# EasyEDA Pro project MushIO_V1p0_Final.eprj, schematic MushIO_V1p0_Final (continued)
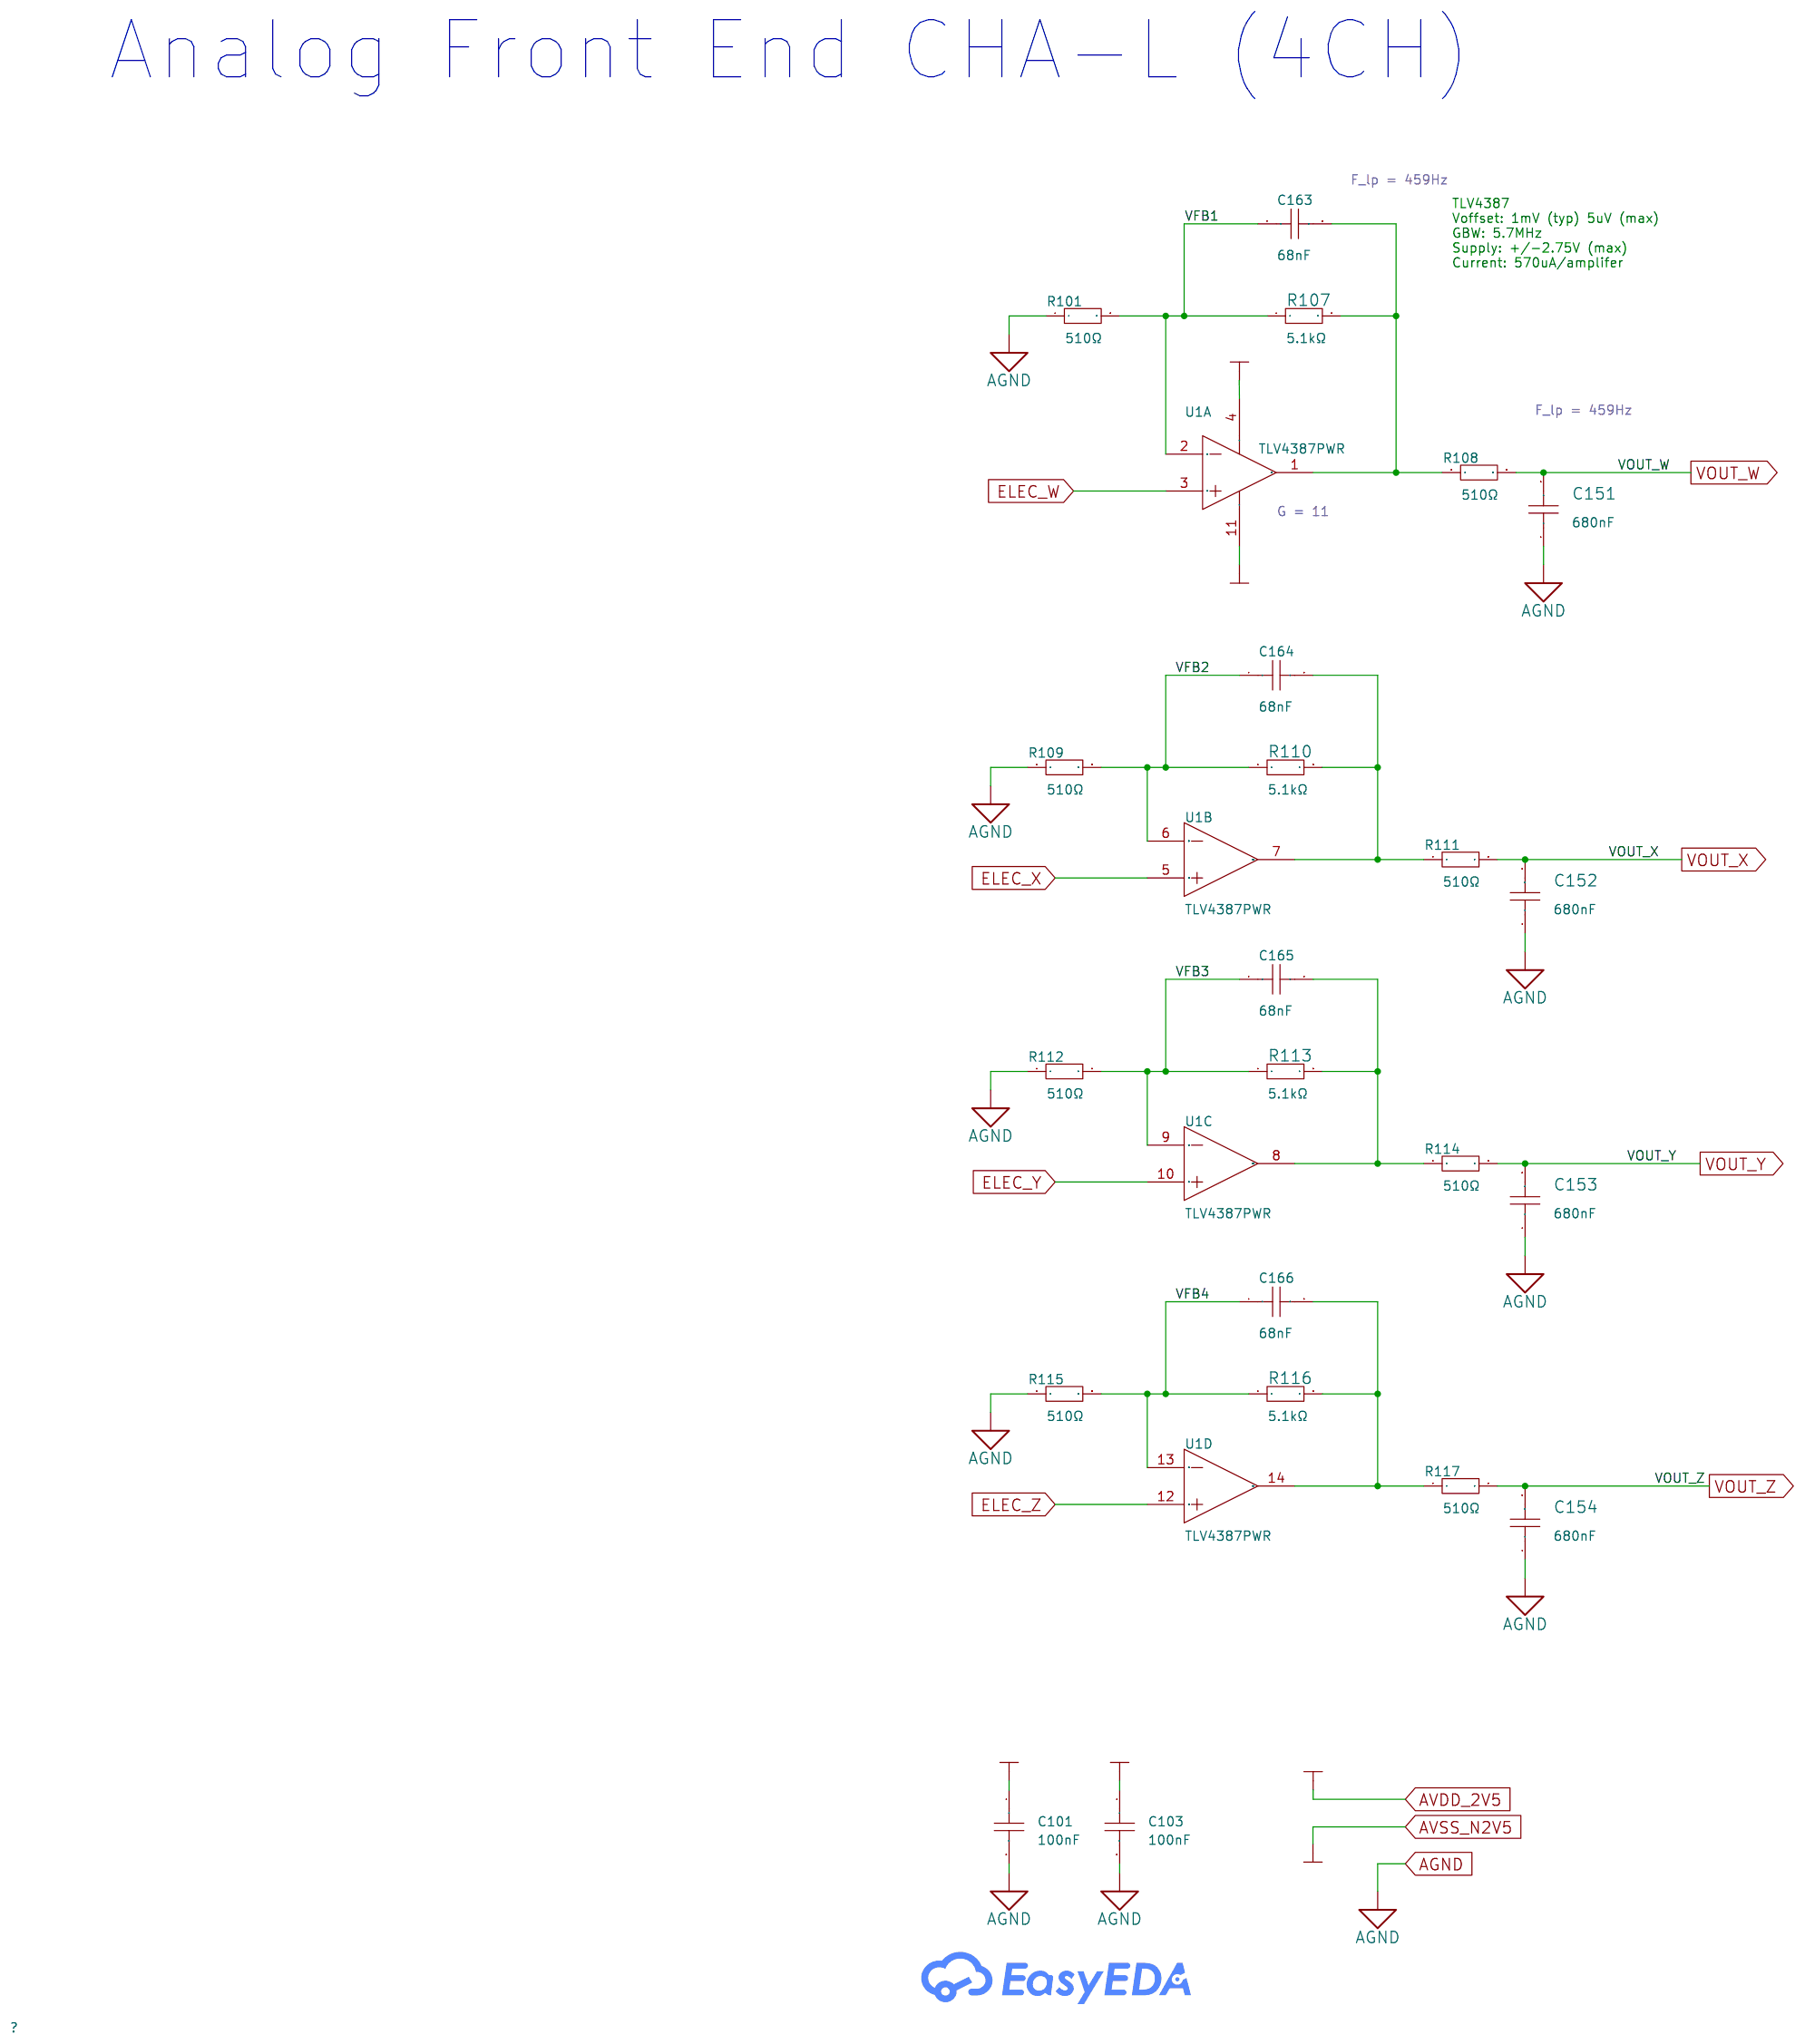
[diagram p0: schematic sheet]
## Library data of the parts
C501 C503-C509 C512 C602 C604 C621 C625 C634-C639 C643 = CL05B104KO5NNNC: Capacitance: Tolerance:±10% Tolerance:±10% Voltage Rated: Temperature Coefficient:; LCSC Part Name: 100nF ±10% 16V; Supplier Part: C1525; Manufacturer: SAMSUNG(三星); Supplier Footprint: 0402; JLCPCB Part Class: Basic Part; Datasheet: https://atta.szlcsc.com/upload/public/pdf/source/20160218/1457707763339.pdf; Supplier: LCSC; Tolerance: ±10%; Check: true
R201-R204 R301-R304 R401-R404 R503-R507 R509-R512 R514-R518 R522-R526 R528 R529 R635 R640 R641 = 0402WGF220JTCE: Type:Thick Film Resistors Resistance:22Ω Tolerance:±1% Tolerance:±1% Power(Watts): Overload Voltage (Max): Temperature Coefficient:±100ppm/℃ Temperature Coefficient:±100ppm/℃ Operating Temperature Range:-55℃~+155℃ Operating Temperature Range:-55℃~+155℃; LCSC Part Name: 22Ω ±1% 62.5mW 厚膜电阻; Supplier Part: C25092; Manufacturer: UNI-ROYAL(厚声); Supplier Footprint: 0402; JLCPCB Part Class: Basic Part; Datasheet: https://atta.szlcsc.com/upload/public/pdf/source/20200306/C422600_1E6D84923E4A46A82E41ADD87F860B5C.pdf; Supplier: LCSC; Type: Thick Film Resistors; Tolerance: ±1%; Temperature Coefficient: ±100ppm/℃; Operating Temperature Range: -55℃~+155℃; Check: true
TP201-TP206 TP301-TP311 TP313-TP320 TP401-TP406 TP501 TP601-TP604 TP607-TP624 TP626-TP631 TP633 TP634 TP636 TP637 TP640-TP642 = RCUCTE: Connector Type:Iron ring type (patch) Plastic Color:No plastic Board Space (Diameter φ/ Length x Width):1.6mmx0.8mm; Supplier Part: C159867; Manufacturer: KOA; JLCPCB Part Class: Extended Part; Datasheet: https://atta.szlcsc.com/upload/public/pdf/source/20171228/C159868_15144411255991213551.pdf; Supplier: LCSC; Connector Type: Iron ring type (patch); Plastic Color: No plastic; Board Space (Diameter φ/ Length x Width): 1.6mmx0.8mm; Check: true
CN101-CN177 = 1508-0-00-15-00-00-03-0: Supplier Part: C17423023; Manufacturer: Mill-Max Mfg. Corp.; JLCPCB Part Class: Extended Part; Datasheet: https://atta.szlcsc.com/upload/public/pdf/source/20241107/0E651D547B45CBA4A1DBDDB5A1203FC4.pdf; Supplier: LCSC; Check: true
L501-L503 = BLM31PG500SN1L: Impedance @ Frequency:50Ω@100MHz Tolerance:±25% Tolerance:±25% DC Resistance:15mΩ Current Rating:3.5A Circuits:1; LCSC Part Name: 单路 1206磁珠 阻抗50Ω@100MHz; Supplier Part: C88997; Manufacturer: muRata(村田); Supplier Footprint: 1206; JLCPCB Part Class: Extended Part; Datasheet: https://atta.szlcsc.com/upload/public/pdf/source/20180326/C88997_FE7208E239BA92CF7577D85CF2703D30.pdf; Supplier: LCSC; Impedance @ Frequency: 50Ω@100MHz; Tolerance: ±25%; DC Resistance: 15mΩ; Current Rating: 3.5A; Circuits: 1; Check: true
R521 R527 R613 R616 R633 R634 R636-R639 R645 R646 = 0402WGF0000TCE: Type:Thick Film Resistors Resistance: Tolerance:±1% Tolerance:±1% Power(Watts): Overload Voltage (Max): Temperature Coefficient:±800ppm/℃ Temperature Coefficient:±800ppm/℃ Operating Temperature Range:-55℃~+155℃ Operating Temperature Range:-55℃~+155℃; LCSC Part Name: 0Ω ±1% 62.5mW 厚膜电阻; Supplier Part: C17168; Manufacturer: UNI-ROYAL(厚声); Supplier Footprint: 0402; JLCPCB Part Class: Basic Part; Datasheet: https://atta.szlcsc.com/upload/public/pdf/source/20200306/C422600_1E6D84923E4A46A82E41ADD87F860B5C.pdf; Supplier: LCSC; Type: Thick Film Resistors; Tolerance: ±1%; Temperature Coefficient: ±800ppm/℃; Operating Temperature Range: -55℃~+155℃; Check: true
C510 C511 C601 C603 C620 C624 C628-C631 = CL10A106KP8NNNC: Capacitance: Tolerance:±10% Tolerance:±10% Voltage Rated: Temperature Coefficient:; LCSC Part Name: 10uF ±10% 10V; Supplier Part: C19702; Manufacturer: SAMSUNG(三星); Supplier Footprint: 0603; JLCPCB Part Class: Basic Part; Datasheet: https://atta.szlcsc.com/upload/public/pdf/source/20160218/1457707763339.pdf; Supplier: LCSC; Tolerance: ±10%; Check: true
C605 C619 = CL10B223KB8NNNC: Capacitance:22nF Tolerance:±10% Tolerance:±10% Voltage Rating:50V Temperature Coefficient:X7R; LCSC Part Name: 22nF ±10% 50V; Supplier Part: C21122; Manufacturer: SAMSUNG(三星); Supplier Footprint: 0603; JLCPCB Part Class: Basic Part; Datasheet: https://item.szlcsc.com/datasheet/CL10B223KB8NNNC/21834.html; Supplier: LCSC; Tolerance: ±10%; Voltage Rating: 50V; Temperature Coefficient: X7R; Check: true
C606 C608 = CC0603KRX7R9BB683: Capacitance:68nF Tolerance:±10% Tolerance:±10% Voltage Rating:50V Temperature Coefficient:X7R; LCSC Part Name: 68nF ±10% 50V; Supplier Part: C107098; Manufacturer: YAGEO(国巨); Supplier Footprint: 0603; JLCPCB Part Class: Extended Part; Datasheet: https://item.szlcsc.com/datasheet/CC0603KRX7R9BB683/108314.html; Supplier: LCSC; Tolerance: ±10%; Voltage Rating: 50V; Temperature Coefficient: X7R; Check: true
C607 C617 = CL21B474KBFNNNE: Capacitance: Tolerance:±10% Tolerance:±10% Voltage Rated: Temperature Coefficient:; LCSC Part Name: 470nF ±10% 50V; Supplier Part: C13967; Manufacturer: SAMSUNG(三星); Supplier Footprint: 0805; JLCPCB Part Class: Basic Part; Datasheet: https://atta.szlcsc.com/upload/public/pdf/source/20160218/1457707763339.pdf; Supplier: LCSC; Tolerance: ±10%; Voltage Rated: 50V; Check: true
C609 C616 = CC0603KRX7R9BB103: Capacitance:10nF Tolerance:±10% Tolerance:±10% Voltage Rating:50V Temperature Coefficient:X7R; LCSC Part Name: 10nF ±10% 50V; Supplier Part: C100042; Manufacturer: YAGEO(国巨); Supplier Footprint: 0603; JLCPCB Part Class: Extended Part; Datasheet: https://item.szlcsc.com/datasheet/CC0603KRX7R9BB103/101256.html; Supplier: LCSC; Tolerance: ±10%; Voltage Rating: 50V; Temperature Coefficient: X7R; Check: true
C610 = CL10B473KB8NNNC: Capacitance:47nF Tolerance:±10% Tolerance:±10% Voltage Rating:50V Temperature Coefficient:X7R; LCSC Part Name: 47nF ±10% 50V; Supplier Part: C1622; Manufacturer: SAMSUNG(三星); Supplier Footprint: 0603; JLCPCB Part Class: Basic Part; Datasheet: https://item.szlcsc.com/datasheet/CL10B473KB8NNNC/1974.html; Supplier: LCSC; Tolerance: ±10%; Voltage Rating: 50V; Temperature Coefficient: X7R; Check: true
C611 C613 = CL21A106KAYNNNE_C15850: Capacitance:10uF Tolerance:±10% Tolerance:±10% Voltage Rating:25V Temperature Coefficient:X5R; LCSC Part Name: 10uF ±10% 25V; Supplier Part: C15850; Manufacturer: SAMSUNG(三星); Manufacturer Part: CL21A106KAYNNNE; Supplier Footprint: 0805; JLCPCB Part Class: Basic Part; Datasheet: https://item.szlcsc.com/datasheet/CL21A106KAYNNNE/16532.html; Supplier: LCSC; Tolerance: ±10%; Voltage Rating: 25V; Temperature Coefficient: X5R; Check: true
C612 C618 = CL10B104KB8NNNC: Capacitance:100nF Tolerance:±10% Tolerance:±10% Voltage Rating:50V Temperature Coefficient:X7R; LCSC Part Name: 100nF ±10% 50V; Supplier Part: C1591; Manufacturer: SAMSUNG(三星); Supplier Footprint: 0603; JLCPCB Part Class: Extended Part; Datasheet: https://item.szlcsc.com/datasheet/CL10B104KB8NNNC/1943.html; Supplier: LCSC; Tolerance: ±10%; Voltage Rating: 50V; Temperature Coefficient: X7R; Check: true
C614 = 0603B182K500NT: Capacitance:1.8nF Tolerance:±10% Tolerance:±10% Voltage Rating:50V Temperature Coefficient:X7R; LCSC Part Name: 1.8nF ±10% 50V; Supplier Part: C1599; Manufacturer: FH(风华); Supplier Footprint: 0603; JLCPCB Part Class: Extended Part; Datasheet: https://item.szlcsc.com/datasheet/0603B182K500NT/1951.html; Supplier: LCSC; Tolerance: ±10%; Voltage Rating: 50V; Temperature Coefficient: X7R; Check: true
C615 = GRM1555C1H101JA01D: Capacitance:100pF Tolerance:±5% Tolerance:±5% Voltage Rating:50V Temperature Coefficient:C0G; LCSC Part Name: 100pF ±5% 50V; Supplier Part: C77177; Manufacturer: muRata(村田); Supplier Footprint: 0402; JLCPCB Part Class: Extended Part; Datasheet: https://item.szlcsc.com/datasheet/GRM1555C1H101JA01D/78305.html; Supplier: LCSC; Tolerance: ±5%; Voltage Rating: 50V; Temperature Coefficient: C0G; Check: true
C622 C623 C626 C642 = CA45-B-16V-47uF-K: Capacitance: Tolerance:±10% Tolerance:±10% Rated Voltage: Equivalent Series Resistance(ESR):3Ω@100kHz Operating Temperature:-55℃~+125℃ Operating Temperature:-55℃~+125℃; LCSC Part Name: 47uF ±10% 16V; Supplier Part: C136751; Manufacturer: CEC(振华新云); Supplier Footprint: CASE-B-3528; JLCPCB Part Class: Extended Part; Datasheet: https://atta.szlcsc.com/upload/public/pdf/source/20200817/C136751_89CB14FC7BB434027D9410E248BC6FA3.pdf; Supplier: LCSC; Tolerance: ±10%; Equivalent Series Resistance(ESR): 3Ω@100kHz; Operating Temperature: -55℃~+125℃; Check: true
C627 C640 = CL05A105KO5NNNC: Capacitance:1uF Tolerance:±10% Tolerance:±10% Voltage Rating:16V Temperature Coefficient:X5R; LCSC Part Name: 1uF ±10% 16V; Supplier Part: C29266; Manufacturer: SAMSUNG(三星); Supplier Footprint: 0402; JLCPCB Part Class: Extended Part; Datasheet: https://item.szlcsc.com/datasheet/CL05A105KO5NNNC/30018.html; Supplier: LCSC; Tolerance: ±10%; Voltage Rating: 16V; Temperature Coefficient: X5R; Check: true
CN178 = A1251WR-S-2P: Pins Structure:1x2P Pitch:1.25mm Mounting Type:Surface Mount, Right Angle Reference Series:- Number of Pins:2P Number of Rows:1 Number of PINs Per Row:2 Row Spacing:- Current Rating:1A Contact Material:Phosphor Bronze Contact Plating:Tin Operating Tempera; LCSC Part Name: 1x2P 间距:1.25mm 卧贴; Supplier Part: C225111; Manufacturer: CJT(长江连接器); Supplier Footprint: SMD,P=1.25mm,卧贴; JLCPCB Part Class: Extended Part; Datasheet: https://item.szlcsc.com/datasheet/A1251WR-S-2P/225394.html; Supplier: LCSC; Pins Structure: 1x2P; Pitch: 1.25mm; Mounting Type: Surface Mount, Right Angle; Number of Pins: 2P; Number of Rows: 1; Number of PINs Per Row: 2; Current Rating: 1A; Contact Material: Phosphor Bronze; Contact Plating: Tin; Operating Temperature: -40℃~+105℃; Voltage Rating: 125V; Plastic Material: LCP; Flame Retardant Rating: UL94V-0
LED601-LED608 = NCD0402R1: 发光颜色:红灯;; Supplier: LCSC; Datasheet: https://atta.szlcsc.com/upload/public/pdf/source/20200820/C130719_A72EA5A7FEC83C35856EA0453E4EE775.pdf; Manufacturer: 国星光电; Emitted Color: 红灯; Supplier Part: C130719; JLCPCB Part Class: 扩展库; Supplier Footprint: 0402; Check: true
Q501 Q601 Q602 = DMG2305UX-7: Number:1 P-Channel Drain to Source Voltage:20V Current - Continuous Drain(Id):5A RDS(on):52mΩ@4.5V；100mΩ@2.5V Pd - Power Dissipation:1.4W Gate Threshold Voltage (Vgs(th)):900mV@250uA Gate Charge(Qg):10.2nC@4.5V Input Capacitance(Ciss):808pF Reverse Transf; LCSC Part Name: 1个P沟道 耐压:20V 电流:5A; Supplier Part: C150470; Manufacturer: DIODES(美台); Supplier Footprint: SOT-23; JLCPCB Part Class: Extended Part; Datasheet: https://item.szlcsc.com/datasheet/DMG2305UX-7/161808.html; Supplier: LCSC; Number: 1 P-Channel; Drain to Source Voltage: 20V; Current - Continuous Drain(Id): 5A; RDS(on): 52mΩ@4.5V；100mΩ@2.5V; Pd - Power Dissipation: 1.4W; Gate Threshold Voltage (Vgs(th)): 900mV@250uA; Gate Charge(Qg): 10.2nC@4.5V; Input Capacitance(Ciss): 808pF; Reverse Transfer Capacitance (Crss@Vds): 77pF; Operating Temperature: -55℃~+150℃; Type: P-Channel; Output Capacitance(Coss): 85pF; Check: true
R601 R614 R618 R620 R622 = PE0402FRF070R1L: LCSC Part Name: 薄膜电阻 100mΩ ±1% 63mW; Supplier Part: C1883533; Manufacturer: YAGEO(国巨); Supplier Footprint: 0402; JLCPCB Part Class: Extended Part; Datasheet: https://item.szlcsc.com/datasheet/PE0402FRF070R1L/1974353.html; Supplier: LCSC; Check: true
R602 R605 R617 R629-R631 R642 = RC0402FR-071K5L: Type:Thick Film Resistor Resistance:1.5kΩ Tolerance:±1% Tolerance:±1% Power(Watts):62.5mW Voltage-Supply(Max):50V Temperature Coefficient:±100ppm/℃ Temperature Coefficient:±100ppm/℃ Operating Temperature:-55℃~+155℃ Operating Temperature:-55℃~+155℃; LCSC Part Name: 厚膜电阻 1.5kΩ ±1% 62.5mW; Supplier Part: C114759; Manufacturer: YAGEO(国巨); Supplier Footprint: 0402; JLCPCB Part Class: Extended Part; Datasheet: https://item.szlcsc.com/datasheet/RC0402FR-071K5L/116003.html; Supplier: LCSC; Type: Thick Film Resistor; Tolerance: ±1%; Power(Watts): 62.5mW; Voltage-Supply(Max): 50V; Temperature Coefficient: ±100ppm/℃; Operating Temperature: -55℃~+155℃; Check: true
R606 R607 = TNPW040242K2BEED: Type:Thin Film Resistor Resistance:42.2kΩ Tolerance:±0.1% Tolerance:±0.1% Power(Watts):100mW Voltage-Supply(Max):50V Temperature Coefficient:±25ppm/℃ Temperature Coefficient:±25ppm/℃ Operating Temperature:-55℃~+155℃ Operating Temperature:-55℃~+155℃; LCSC Part Name: 薄膜电阻 42.2kΩ ±0.1% 100mW; Supplier Part: C2093255; Manufacturer: VISHAY(威世); Supplier Footprint: 0402; JLCPCB Part Class: Extended Part; Datasheet: https://item.szlcsc.com/datasheet/TNPW040242K2BEED/2184846.html; Supplier: LCSC; Type: Thin Film Resistor; Tolerance: ±0.1%; Power(Watts): 100mW; Voltage-Supply(Max): 50V; Temperature Coefficient: ±25ppm/℃; Operating Temperature: -55℃~+155℃; Check: true
R608 = FRC0402F1100TS: Type:Thick Film Resistor Resistance:110Ω Tolerance:±1% Tolerance:±1% Power(Watts):62.5mW Voltage-Supply(Max):50V Temperature Coefficient:±100ppm/℃ Temperature Coefficient:±100ppm/℃ Operating Temperature:-55℃~+155℃ Operating Temperature:-55℃~+155℃; LCSC Part Name: 110Ω ±1% 62.5mW 厚膜电阻; Supplier Part: C2909312; Manufacturer: FOJAN(富捷); Supplier Footprint: 0402; JLCPCB Part Class: Extended Part; Supplier: LCSC; Type: Thick Film Resistor; Tolerance: ±1%; Power(Watts): 62.5mW; Voltage-Supply(Max): 50V; Temperature Coefficient: ±100ppm/℃; Operating Temperature: -55℃~+155℃; Check: true
R609 R612 = NTCS0603E3103JMT: Resistance @ 25℃: B Constant (25℃/50℃):- Resistance Tolerance: B Constant (25℃/75℃):- B Constant (25℃/85℃):3610K B Constant (25℃/100℃):- Power: B Constant Tolerance: Steady State Current (Max):- Operating Temperature:-40℃~+150℃ Operating Temperature:-40℃~; LCSC Part Name: 10kΩ 电阻精度:±5%; Supplier Part: C154082; Manufacturer: VISHAY(威世); Supplier Footprint: 0603; JLCPCB Part Class: Extended Part; Datasheet: https://atta.szlcsc.com/upload/public/pdf/source/20171201/C154082_15121210821531157111.pdf; Supplier: LCSC; B Constant (25℃/85℃): 3610K; Operating Temperature: -40℃~+150℃; Check: true
R610 R611 = 0402WGF2000TCE: Type:Thick Film Resistor Resistance:200Ω Tolerance:±1% Tolerance:±1% Power(Watts):62.5mW Voltage-Supply(Max):50V Temperature Coefficient:±100ppm/℃ Temperature Coefficient:±100ppm/℃ Operating Temperature:-55℃~+155℃ Operating Temperature:-55℃~+155℃; LCSC Part Name: 200Ω ±1% 62.5mW 厚膜电阻; Supplier Part: C25087; Manufacturer: UNI-ROYAL(厚声); Supplier Footprint: 0402; JLCPCB Part Class: Basic Part; Datasheet: https://item.szlcsc.com/datasheet/0402WGF2000TCE/25830.html; Supplier: LCSC; Type: Thick Film Resistor; Tolerance: ±1%; Power(Watts): 62.5mW; Voltage-Supply(Max): 50V; Temperature Coefficient: ±100ppm/℃; Operating Temperature: -55℃~+155℃; Check: true
R615 = RC0402FR-07100KL: 电阻类型:厚膜电阻;阻值:100kΩ;精度:±1%;功率:62.5mW;最大工作电压:50V;温度系数:±100ppm/℃;; LCSC Part Name: 厚膜电阻 100kΩ ±1% 62.5mW; Supplier Part: C60491; Manufacturer: YAGEO(国巨); Supplier Footprint: 0402; JLCPCB Part Class: Extended Part; Datasheet: https://atta.szlcsc.com/upload/public/pdf/source/20180927/C295883_E8D83085EA81BD7DE0B2B681138C15EE.pdf; Supplier: LCSC; Type: 厚膜电阻; Tolerance: ±1%; Power(Watts): 62.5mW; Overload Voltage (Max): 50V; Temperature Coefficient: ±100ppm/℃; Operating Temperature Range: -55℃~+155℃; Check: true
R519 R520 R530 R619 R624 R627 R628 = 0402WGF1003TCE: Type:Thick Film Resistor Resistance:100kΩ Tolerance:±1% Tolerance:±1% Power(Watts):62.5mW Voltage-Supply(Max):50V Temperature Coefficient:±100ppm/℃ Temperature Coefficient:±100ppm/℃ Operating Temperature:-55℃~+155℃ Operating Temperature:-55℃~+155℃; LCSC Part Name: 100kΩ ±1% 62.5mW 厚膜电阻; Supplier Part: C25741; Manufacturer: UNI-ROYAL(厚声); Supplier Footprint: 0402; JLCPCB Part Class: Basic Part; Datasheet: https://item.szlcsc.com/datasheet/0402WGF1003TCE/26484.html; Supplier: LCSC; Type: Thick Film Resistor; Tolerance: ±1%; Power(Watts): 62.5mW; Voltage-Supply(Max): 50V; Temperature Coefficient: ±100ppm/℃; Operating Temperature: -55℃~+155℃; Check: true
R621 R623 = FRC0402F1103TS: Type:Thick Film Resistor Resistance:110kΩ Tolerance:±1% Tolerance:±1% Power(Watts):62.5mW Voltage-Supply(Max):50V Temperature Coefficient:±100ppm/℃ Temperature Coefficient:±100ppm/℃ Operating Temperature:-55℃~+155℃ Operating Temperature:-55℃~+155℃; LCSC Part Name: 110kΩ ±1% 62.5mW 厚膜电阻; Supplier Part: C2909311; Manufacturer: FOJAN(富捷); Supplier Footprint: 0402; JLCPCB Part Class: Extended Part; Supplier: LCSC; Type: Thick Film Resistor; Tolerance: ±1%; Power(Watts): 62.5mW; Voltage-Supply(Max): 50V; Temperature Coefficient: ±100ppm/℃; Operating Temperature: -55℃~+155℃; Check: true
R625 R626 R632 R643 R644 = 0402WGF5100TCE: Type:Thick Film Resistors Resistance: Tolerance:±1% Tolerance:±1% Power(Watts): Overload Voltage (Max): Temperature Coefficient:±100ppm/℃ Temperature Coefficient:±100ppm/℃ Operating Temperature Range:-55℃~+155℃ Operating Temperature Range:-55℃~+155℃; LCSC Part Name: 510Ω ±1% 62.5mW 厚膜电阻; Supplier Part: C25123; Manufacturer: UNI-ROYAL(厚声); Supplier Footprint: 0402; JLCPCB Part Class: Basic Part; Datasheet: https://atta.szlcsc.com/upload/public/pdf/source/20200306/C422600_1E6D84923E4A46A82E41ADD87F860B5C.pdf; Supplier: LCSC; Type: Thick Film Resistors; Tolerance: ±1%; Temperature Coefficient: ±100ppm/℃; Operating Temperature Range: -55℃~+155℃; Check: true
U601 = BQ24040DSQR: The Chip Type:- Voltage - Supply:3.5V~28V Voltage - Supply:3.5V~28V Charge Current - Max:- Charging Saturation Voltage:4.2V; Supplier Part: C81080; Manufacturer: TI(德州仪器); Supplier Footprint: WSON-10-EP(2x2); JLCPCB Part Class: Extended Part; Datasheet: https://www.ti.com/cn/lit/gpn/bq24040; Supplier: LCSC; Voltage - Supply: 3.5V~28V; Charging Saturation Voltage: 4.2V; Check: true
U602 = BQ51013CRHLR: Voltage - Supply:4V~7V Voltage - Supply:4V~7V Operating Temperature:0℃~+125℃ Operating Temperature:0℃~+125℃ Battery Temperature Detection:Support Supply Current (Iq):20uA; Supplier Part: C43043533; Manufacturer: TI(德州仪器); Supplier Footprint: VQFN-20(3.5x4.5); JLCPCB Part Class: Extended Part; Datasheet: https://www.ti.com.cn/cn/lit/ds/symlink/bq51013c.pdf; Supplier: LCSC; Voltage - Supply: 4V~7V; Operating Temperature: 0℃~+125℃; Battery Temperature Detection: Support; Supply Current (Iq): 20uA; Check: true
U603 = ME6217C33M5G: 输出类型:固定;输出极性:正;最大输入电压:7V;输出电压:3.3V;输出电流:800mA;电源纹波抑制比(PSRR):65dB@(1kHz);; Supplier: LCSC; Datasheet: https://atta.szlcsc.com/upload/public/pdf/source/20190910/C427602_D4B9162A2E9D9EF57C60010DFDECEF37.pdf; Output Type: 固定; Manufacturer: MICRONE(南京微盟); Supplier Part: C427602; Output Current: 800mA; Output Voltage: 3.3V; Dropout Voltage: 180mV@(300mA); Output Polarity: 正; JLCPCB Part Class: 扩展库; Number of Outputs: 1; Supplier Footprint: SOT-23-5; Maximum Input Voltage: 7V; Power Supply Rejection Ratio (PSRR): 65dB@(1kHz); Check: true
U604 = LM27762DSSR: LCSC Part Name: 低噪声正负输出集成电荷泵加LDO; Supplier Part: C473398; Manufacturer: TI(德州仪器); Supplier Footprint: WSON-12-EP(2x3); JLCPCB Part Class: Extended Part; Datasheet: https://www.ti.com/cn/lit/gpn/lm27762; Supplier: LCSC; Check: true
U605-U610 = 1502-2: Supplier Part: C4355001; Manufacturer: Keystone; JLCPCB Part Class: Extended Part; Datasheet: https://item.szlcsc.com/datasheet/1502-2/4925166.html; Supplier: LCSC; Check: true
C513 C514 = CC0402KRX5R6BB684: Capacitance:680nF Tolerance:±10% Tolerance:±10% Voltage Rating:10V Temperature Coefficient:X5R; LCSC Part Name: 680nF ±10% 10V; Supplier Part: C113784; Manufacturer: YAGEO(国巨); Supplier Footprint: 0402; JLCPCB Part Class: Extended Part; Datasheet: https://item.szlcsc.com/datasheet/CC0402KRX5R6BB684/115020.html; Supplier: LCSC; Tolerance: ±10%; Voltage Rating: 10V; Temperature Coefficient: X5R; Check: true
R501 R502 = RC0402FR-074K7L: Type:Thick Film Resistor Resistance:4.7kΩ Tolerance:±1% Tolerance:±1% Power(Watts):62.5mW Voltage-Supply(Max):50V Temperature Coefficient:±100ppm/℃ Temperature Coefficient:±100ppm/℃ Operating Temperature:-55℃~+155℃ Operating Temperature:-55℃~+155℃; LCSC Part Name: 厚膜电阻 4.7kΩ ±1% 62.5mW; Supplier Part: C105871; Manufacturer: YAGEO(国巨); Supplier Footprint: 0402; JLCPCB Part Class: Extended Part; Datasheet: https://item.szlcsc.com/datasheet/RC0402FR-074K7L/107086.html; Supplier: LCSC; Type: Thick Film Resistor; Tolerance: ±1%; Power(Watts): 62.5mW; Voltage-Supply(Max): 50V; Temperature Coefficient: ±100ppm/℃; Operating Temperature: -55℃~+155℃; Check: true
U501 = 59170-1-S-00-D: LCSC Part Name: 超小型复模簧片开关; Supplier Part: C315909; Manufacturer: Littelfuse(美国力特); Supplier Footprint: SMD; JLCPCB Part Class: Extended Part; Datasheet: https://item.szlcsc.com/datasheet/59170-1-S-00-D/297544.html; Supplier: LCSC; Check: true
U502 = Raspberry Pi Pico 2W: Supplier Part: C42394205; Manufacturer: Raspberry Pi(树莓派); JLCPCB Part Class: Extended Part; Datasheet: https://item.szlcsc.com/datasheet/Raspberry%2520Pi%2520Pico%25202W/44334737.html; Supplier: LCSC; Check: true
U503 = P3T1755DPZ: Supplier Part: C20234292; Manufacturer: NXP(恩智浦); Supplier Footprint: TSSOP-8; JLCPCB Part Class: Extended Part; Datasheet: https://www.nxp.com/docs/en/data-sheet/P3T1755.pdf; Supplier: LCSC; Check: true
U504 = LIS2DH12TR: Accelerometer Sensing Axis:X,Y,Z Acceleration Measurement Range (MAX):±16g Acceleration Measurement Range (MAX):±16g Sensor Type:Accelerometer Interface:I2C；SPI Voltage - Supply:1.71V~3.6V Voltage - Supply:1.71V~3.6V Standby Current:500nA Operating Temper; Supplier Part: C110926; Manufacturer: ST(意法半导体); Supplier Footprint: LGA-12(2x2); JLCPCB Part Class: Extended Part; Datasheet: https://item.szlcsc.com/datasheet/LIS2DH12TR/112151.html; Supplier: LCSC; Accelerometer Sensing Axis: X,Y,Z; Acceleration Measurement Range (MAX): ±16g; Sensor Type: Accelerometer; Interface: I2C；SPI; Voltage - Supply: 1.71V~3.6V; Standby Current: 500nA; Operating Temperature: -40℃~+85℃; Check: true
U505 = CDCLVC1106PWR: Output Frequency(Max):250MHz Voltage - Supply:2.3V~3.6V Voltage - Supply:2.3V~3.6V Operating Temperature:-40℃~+85℃ Operating Temperature:-40℃~+85℃; Supplier Part: C56506; Manufacturer: TI(德州仪器); Supplier Footprint: TSSOP-14; JLCPCB Part Class: Extended Part; Datasheet: http://www.ti.com/cn/lit/gpn/cdclvc1106; Supplier: LCSC; Output Frequency(Max): 250MHz; Voltage - Supply: 2.3V~3.6V; Operating Temperature: -40℃~+85℃; Check: true
X501 = SiT1602BI-82-33E-4.096000: Frequency:4.096MHz Frequency Stability:±25ppm Frequency Stability:±25ppm Output Type:LVCMOS；HCMOS Voltage - Supply:3.3V Voltage - Supply:3.3V Current - Supply:4.5mA Operating Temperature:-40℃~+85℃ Operating Temperature:-40℃~+85℃; LCSC Part Name: 4.096MHz ±25ppm LVCMOS HCMOS 3.3V; Supplier Part: C348005; Manufacturer: SITIME; Supplier Footprint: SMD7050-4P; JLCPCB Part Class: Extended Part; Datasheet: https://item.szlcsc.com/datasheet/SiT1602BI-82-33E-4.096000/324600.html; Supplier: LCSC; Frequency Stability: ±25ppm; Output Type: LVCMOS；HCMOS; Voltage - Supply: 3.3V; Current - Supply: 4.5mA; Operating Temperature: -40℃~+85℃; Check: true

## Nets
AGND: C501.1 C503.1 C503.2 C504.1 C505.1 C506.1 C507.1 C508.1 C509.1 C509.2 C510.1 C510.2 C511.1 C511.2 C512.1 C513.1 C514.1 C601.1 C602.2 C603.1 C604.2 C611.1 C612.1 C613.1 C618.1 C620.1 C621.2 C622.2 C623.2 C624.1 C625.2 C626.2 C628.1 C629.1 C630.1 C631.1 C634.1 C634.2 C635.1 C635.2 C636.1 C636.2 C637.1 C637.2 C638.1 C638.2 C639.1 C639.2 C640.1 C642.2 C643.1 C643.2 CBB1.(AVDD_2V5) CBB2.(VOUT_Z) CBB3.(VOUT_Z) CBB4.(VOUT_Z) CBB5.(VOUT_Z) CBB6.(VOUT_Z) CBB7.(VOUT_Z) CBB8.(AVDD_2V5) CBB9.(AVDD_2V5) CBB10.(AVDD_2V5) CBB14.(VOUT_Z) CBB15.(VOUT_Z) CBB18.(VOUT_Z) CBB19.(VOUT_Z) CBB20.(VOUT_Z) CBB21.(VOUT_Z) CBB22.(VOUT_Z) CBB23.(VOUT_Z) CBB24.(VOUT_Z) CBB25.(VOUT_Z) CBB34.(AVDD_2V5) CBB35.(AVDD_2V5) CN101.1 CN102.1 CN103.1 CN104.1 CN105.1 CN106.1 CN107.1 CN108.1 CN109.1 CN110.1 CN111.1 CN112.1 CN113.1 CN114.1 CN115.1 CN116.1 CN117.1 CN118.1 CN119.1 CN120.1 CN121.1 CN122.1 CN123.1 CN124.1 CN125.1 CN126.1 CN127.1 CN128.1 CN129.1 CN130.1 CN131.1 CN132.1 CN133.1 CN134.1 CN135.1 CN136.1 CN137.1 CN138.1 CN139.1 CN140.1 CN141.1 CN142.1 CN143.1 CN144.1 CN145.1 CN146.1 CN147.1 CN148.1 CN149.1 CN150.1 CN151.1 CN152.1 CN153.1 CN154.1 CN155.1 CN156.1 CN157.1 CN158.1 CN159.1 CN160.1 CN161.1 CN162.1 CN163.1 CN164.1 CN165.1 CN168.1 CN169.1 CN170.1 CN171.1 CN173.1 CN174.1 CN176.1 CN177.1 CN178.1 CN178.3 CN178.4 L501.1 L502.1 L502.2 L503.1 LED604.2(A) LED605.2(A) LED606.2(A) R201.1 R202.1 R203.1 R204.1 R301.1 R302.1 R303.1 R304.1 R401.1 R402.1 R403.1 R404.1 R501.2 R502.2 R505.1 R506.1 R507.1 R509.1 R510.1 R511.2 R512.2 R514.1 R515.1 R516.1 R517.1 R518.1 R519.2 R523.2 R524.1 R525.2 R526.2 R528.2 R529.2 R530.1 R609.1 R610.1 R611.1 R612.1 R614.2 R617.1 R618.1 R619.2 R620.2 R622.2 R624.1 R625.1 R626.1 R627.1 R628.2 R632.1 R636.1 R637.1 R638.1 R639.1 R642.1 R643.1 R644.1 R645.2 TP201.1 TP203.1 TP204.1 TP206.1 TP301.1 TP303.1 TP304.1 TP306.1 TP307.1 TP309.1 TP310.1 TP311.1 TP313.1 TP314.1 TP315.1 TP316.1 TP317.1 TP318.1 TP320.1 TP401.1 TP403.1 TP404.1 TP406.1 TP608.1 TP609.1 TP610.1 TP611.1 TP612.1 TP613.1 TP614.1 TP615.1 TP616.1 TP617.1 TP618.1 TP619.1 TP621.1 TP622.1 TP623.1 TP624.1 TP626.1 TP627.1 TP628.1 TP629.1 TP636.1 TP637.1 TP640.1 TP641.1 TP642.1 U501.2 U502.3(GND) U502.8(GND) U502.13(GND) U502.18(GND) U502.23(GND) U502.28(GND) U502.33(GND_AGND) U502.38(GND) U503.4(GND) U503.5(A2) U503.6(A1) U503.7(A0) U503.8(VCC) U504.2(CS) U504.3(SDO/SA0) U504.5(RES) U504.6(GND) U504.7(GND) U504.8(GND) U504.9(VDD) U504.10(VDD_IO) U505.4(GND) U505.7(GND) U505.10(GND) U601.3(VSS) U601.7(ISET2) U601.11(EP) U602.1(PGND) U602.10(EN1) U602.11(EN2) U602.20(PGND) U602.21(EP) U603.2(VSS) U604.4(GND) U604.13(EP) U605.1 U606.1 U607.1 U608.1 U609.1 U610.1 X501.2(GND)
AVDD_EN: R619.1 U604.12(EN+)
AVDD_FBP: R621.1 R624.2 U604.2(FB+)
AVSS_EN: R628.1 U604.8(EN–)
AVSS_FB: R623.1 R627.2 U604.7(FB–)
AVSS_OUT: C630.2 R622.1 R623.2 U604.6(OUT–)
DVDD_3V3_FILTCLK: C504.2 C505.2 C506.2 C507.2 C512.2 C513.2 C514.2 L501.2 R520.2 U505.5(VDD) U505.8(VDD) U505.12(VDD) X501.4(VDD)
DVDD_5V0: Q501.3(D) R601.2 R616.2 R633.2 R634.2 TP602.1 TP630.1 U601.1(IN)
VBAT_3V7: C603.2 C604.1 CN178.2 R602.2 R605.2 R613.2 R633.1 R634.1 TP631.1 U601.10(OUT)
VBUS_5P0: Q501.1(G) R646.2 U502.40(VBUS)
VIN3V3LDO: C624.2 C625.1 R613.1 R615.1 R616.1 U603.1(VIN)
4P096MHZ_CLK: C508.2 R522.2 U505.1(CLKIN)
4P096MHZ_CLK_OUT: R522.1 X501.3(OUT)
AC1: C605.1 C606.2 C607.1 C608.2 C609.1 C610.2 C614.2 C615.2 U602.2(AC1)
AC1_CAP: C606.1 C608.1 C610.1 TP603.1
AC2: C614.1 C615.1 C616.1 C617.1 C619.1 TP604.1 U602.19(AC2)
AD_5P0: C640.2 Q601.3(D) R646.1 U602.9(AD)
AD_EN#: Q601.1(G) Q602.1(G) U602.8(AD-EN#)
ADC_CLK_EN: R520.1 R521.2 R527.2 R530.2
ANA_PGOOD: U502.34(GP28_ADC2) U604.1(PGOOD)
BATT_TS: R612.2 U601.9(TS)
BOOT1: C609.2 U602.3(BOOT1)
BOOT2: C616.2 U602.17(BOOT2)
CFLYN: C627.1 U604.9(C1–)
CFLYP: C627.2 U604.10(C1+)
CHRG_ISET: R629.2 U601.2(ISET)
CHRG_LED_CHG: LED601.1(K) U601.8(CHG#)
CHRG_PGLED: LED603.1(K) U601.5(PG#)
CLKFAN_EN: R527.1 U505.2(1G)
CLKFAN_Y0: R524.2 U505.3(Y0)
CLKFAN_Y1: R523.1 U505.14(Y1)
CLKFAN_Y2: R526.1 U505.11(Y2)
CLKFAN_Y3: R525.1 U505.13(Y3)
CLKFAN_Y4: R528.1 U505.6(Y4)
CLKFAN_Y5: R529.1 U505.9(Y5)
CLMP1: C607.2 U602.5(CLAMP1)
CLMP2: C617.2 U602.16(CLAMP2)
COM1: C605.2 U602.6(COMM1)
COM2: C619.2 U602.15(COMM2)
ELEC_SHIELD_AGND: L503.2
FOD: C618.2 R606.1 R607.1 R608.1 R610.2 R611.2 U602.14(FOD)
GP0_I2C0_SDA: R503.2 U502.1(GP0_SPI0RX_I2C0SDA_UART0TX)
GP1_I2C0_SCL: R504.2 U502.2(GP1_SPI0CSn_I2C0SCL_UART0RX)
I2C0_SCL: R501.1 R504.1 U503.2(SCL) U504.1(SCL/SPC)
I2C0_SDA: R502.1 R503.1 U503.1(SDA) U504.4(SDA/SDI/SDO)
ILIM: R608.2 U602.12(ILIM)
OUT: C601.2 C602.1 Q602.3(D) R601.1 R631.2 TP601.1 U602.4(OUT)
PFETMID: Q601.2(S) Q602.2(S)
RASPI_RX: R640.1 TP633.1
RASPI_TX: R641.1 TP634.1
RECT: C611.2 C612.2 C613.2 R606.2 R607.2 U602.18(RECT)
SPI0_ADC0_DRDY_N: R202.2 TP202.1 U502.9(GP6_SPI0SCK_I2C1SDA)
SPI0_ADC1_DRDY_N: R204.2 TP205.1 U502.11(GP8_SPI1RX_I2C0SDA_UART1TX)
SPI0_ADC2_DRDY_N: R302.2 TP302.1 U502.14(GP10_SPI1SCK_I2C1SDA)
SPI0_SDO: R201.2 R203.2 R301.2 TP305.1 U502.6(GP4_SPI0RX_I2C0SDA_UART1TX)
SPI1_ADC3_DRDY_N: R304.2 TP319.1 U502.31(GP26_ADC0_I2C1SDA)
SPI1_ADC4_DRDY_N: R402.2 TP402.1 U502.22(GP17_SPI0CSn_UART0TX)
SPI1_ADC5_DRDY_N: R404.2 TP405.1 U502.25(GP19_SPI0TX_I2C1SCL)
SPI1_SDO: R303.2 R401.2 R403.2 TP308.1 U502.21(GP16_SPI0RX_UART0RX)
STATUS_LED: LED607.2(A) LED608.2(A) U502.29(GP22)
TEMP_ALERT#: R519.1 U503.3(ALERT#)
TS: R609.2 U602.13(TS/CTRL)
UART0RX: R640.2 U502.17(GP13_SPI1CSn_I2C0SCL_UART0RX)
UART0TX: R641.2 U502.16(GP12_SPI1RX_I2C0SDA_UART0TX)
VOUT3V3LDO: C620.2 C621.1 C622.1 C623.1 R614.1 TP607.1 U603.5(VOUT)
$3N20860: CN166.1 R636.2
$3N20912: CN167.1 R637.2
$3N20964: CN172.1 R638.2
$3N21016: CN175.1 R639.2
$27N18037: LED604.1(K) R617.2
$27N40841: C629.2 U604.5(CP)
$27N42351: C626.1 R618.2 TP620.1 U604.3(VIN)
$27N42738: R615.2 U603.3(CE)
$27N52678: LED601.2(A) R602.1
$27N52755: LED602.2(A) R630.1
$27N52757: LED602.1(K) U602.7(CHG#)
$27N53034: LED603.2(A) R605.1
$27N53649: LED605.1(K) R625.2
$27N53722: LED606.1(K) R626.2
$27N57001: R630.2 R631.1
$27N57079: R629.1 R632.2
$27N57106: C628.2 R620.1 R621.2 U604.11(OUT+)
$27N69186: R645.1 U601.4(PRETERM)
$46N1996: R506.2 U502.5(GP3_SPI0TX_I2C1SCL)
$46N3529: R521.1 X501.1(OE/ST#/NC)
$46N4291: R518.2 U502.20(GP15_SPI1TX_I2C1SCL)
$46N4295: R517.2 U502.19(GP14_SPI1SCK_I2C1SDA)
$46N5309: R511.1 U502.26(GP20_I2C0SDA)
$46N5316: R512.1 U502.27(GP21_I2C0SCL)
$46N5368: R505.2 U502.4(GP2_SPI0SCK_I2C1SDA)
$46N5421: R507.2 U502.7(GP5_SPI0CSn_I2C0SCL_UART1RX)
$46N5571: R509.2 U502.10(GP7_SPI0TX_I2C1SCL)
$46N5589: R510.2 U502.12(GP9_SPI1CSn_I2C0SCL_UART1RX)
$46N5692: R514.2 U502.15(GP11_SPI1TX_I2C1SCL)
$46N5853: R515.2 U502.24(GP18_SPI0SCK_I2C1SDA)
$46N7956: C642.1 Q501.2(S) U502.39(VSYS)
$46N8063: C501.2 U502.35(ADC_VREF) U502.36(3V3(OUT))
$46N10835: C631.2 R635.2 U501.1
$46N10838: R635.1 TP501.1
$46N12670: R516.2 U502.32(GP27_ADC1_I2C1SCL)
$46N14776: LED607.1(K) R642.2
$46N14946: LED608.1(K) R643.2 R644.2

Not connected (* = marked no-connect by the designer): U502 30(RUN)* 37(3V3_EN)* TP1* TP2* TP3* TP4* TP5* TP6*; U504 11(INT2)* 12(INT1)*; U601 6(NC)*; U603 4(NC)*

## Notes on the sheets
sheet 1
- Electrode Array
- ELEC 00
- ELEC 70
- ELEC 07
- ELEC 77
- AGND Corners
- STIM Electrodes
- Electrode Single Point GND Shield
- ELEC_SHIELD
- Float to AGND but avoid surface currents
sheet 2
- Bypass if not using BATT
- Rail Originates Here
- either VBUS or from Qi Charger
- Rail Originates Here
- Power
- Battery Charger
- Wireless Qi RX Coil
- Fv = 1.8V @5mA
  (3.7-1.8)/1500 = 1.3mA
- ISET Charge Current
  570/210 = 271mA
- Coil
  C22381709
  43x31.5
  11.5uH
- Fv = 1.8V @5mA
  (5.0-1.7)/3000 = 1.1mA
- Fv = 1.8V @5mA
  (3.7-1.8)/1500 = 1.3mA
- 0-50C Limit with 10k NTC
  Place by Battery
- About 1.5A
- 0-50C Limit with 10k NTC
  Place by IC
- Battery
- LP402535
  37x25.5x4.3mm
  320mAh
  0.5A Max discharge
  0.2A Max constant
- LDO DVDD_3V3
- Rail Originate Here
- Fv = 1.8V @5mA
  (3.3-1.8)/1500 = 1.1mA
- 800mA
- Test Points
- Dual Rail Charge Pump LDO
- Rail Originate Here
- 2.52V
- *Whoever made this symbol must hate me
- GND Net Tie
- Fv = 1.8V @5mA
  (2.5-1.8)/1500 = 1.4mA
- VOUT+ = 1.2V × (R1 + R2) / R2
  = 1.2V × (110k + 100k) / 100k
  = 1.2V × 2.1
  = 2.52V
- -2.56V
- VOUT- = -1.22V × (R3 + R4) / R4
  = -1.22V × (110k + 100k) / 100k
  = -1.22V × 2.1
  = -2.56V
- Rail Originate Here
- Turret Standoffs
- REF Circuits
sheet 3
- Electrode AFE MUX Array CH0-23
- ADC0 SPI Test Points
- GND Low Impedance Tie
- ADC0
- DC Net Tie at Charge Pump LDO
- ADC1 SPI Test Points
- GND Low Impedance Tie
- ADC1
- DC Net Tie at Charge Pump LDO
sheet 4
- Digital Block Diagram
- Analog Block Diagram
- Electrode Layout
- 12ch_segment
- RLD (GND)
- ADC PGA
  Another x4 w digital gain
- 00
- ADC0
- ADC1
- 07
- Electrode
- X11
- x1-32
- ADC 24-Bit
- TX Electrode
- 2-pole
  Fc = 459Hz
- 1uV-10mV
  0.1mHz - 1Hz
- TLV4387
  Voffset: 1mV (typ) 5uV (max)
  GBW: 5.7MHz
  Rejected Alt: OPA4387
- ADS124S08
  24bit
  12ch
  4ksps max
  200 SPS practical w mux
  timing w 12ch
  Rejected Alt: ADS1258
- ADC2
- ADC3
- 70
- ADC4
- ADC5
- 77
- Mechanical Idea
- Oring 140mm OD 136 ID 2mm width
- Electrode = 3.18mm
- Pin Base = 1.14mm
- PCB = 1.6mm
- Turret = 5.6mm
- Pico = 4mm
- Petri Dish h = 20mm
- Petri Dish diameter = 143mm across 140mm fits well
- Power Tree
- Mushroom Studies Whitepapers
- ADC Calculations
- Sampling Rate
- Power Estimates
- Maximum theoretical per channel: ~333 SPS (4000 SPS ÷ 12 channels)
  1/(12*406us) = 205 SPS practical with all channels running
- AVSS_N2V5
  ADC_ADS124S08_Converting = 12mA * 6
  AFE_TLV4387_QuiscentMax = 0.7mA * 64
  Total = 117mA
  AVDD_2V5
  ADC_ADS124S08_Converting = 12mA * 6
  AFE_TLV4387_QuiscentMax = 0.7 * 64
  Total = 117mA
  DVDD_3V3
  ADC Dig = 1.4mA * 6
  MCU_RP2350_Peak = 150mA
  Clock Osc = 15mA
  Fanout Buffer = 10mA
  LED Power = 7.6mA
  LED Status Flash = 7.1mA (duty cycled)
  Total = 190mA
  VBAT Max Current = 424mA
  System Power Max = 1.1W
- V2 Feature List
- - ESP32-S3-WROOM-1-N16 for future MCU?
  - ESD diodes and series R on electrodes? Only if it's an issue else focus on best noise performance.
  - Move to 0201 comp
sheet 5
- Electrode AFE MUX Array CH0-23
- ADC2 SPI Test Points
- Common SPI Test Points
- GND Low Impedance Tie
- ADC2
- DC Net Tie at Charge Pump LDO
- ADC3 SPI Test Points
- GND Low Impedance Tie
- ADC3
- DC Net Tie at Charge Pump LDO
sheet 6
- Electrode AFE MUX Array CH0-23
- ADC4 SPI Test Points
- GND Low Impedance Tie
- ADC4
- DC Net Tie at Charge Pump LDO
- ADC5 SPI Test Points
- GND Low Impedance Tie
- ADC5
- DC Net Tie at Charge Pump LDO
sheet 7
- RasPi Pico 2 W
- Route to BOOTSEL on RasPi to allow reprogramming when potted
- PFET diode ORs with RasPi Diode to
  select VSYS via VBUS or from wireless charger
- Reed Switch
- Pulled to VSYS via 100k onboard
- Pulled to VSYS via 50k onboard
- Fv = 1.8V @5mA
  (3.3-1.8)/1500 = 1.1mA
- ~200mA max with wireless running
- Fv = 1.8V @5mA
  (3.3-1.8)/255 = 6.0mA
- Temp Sensor
- Open Drain Not used
- ADC Clock
- I2C Address
  0x40
- IMU + Temp Sensor
- E for OutputEnable Variant
  Low = HiZ Out
  High  = Output
  Default Rise Time
- Push-Pull Int Not used
- ADC_CLK_EN
  HiZ Out = ON
  High  = ON
  Low = Internal CLK
- I2C Address
  0x18
- Length match CLK traces to <5mm
- Rail Originates Here
